# EasyEDA Pro project Geacon3.eprj, board Geacon_1
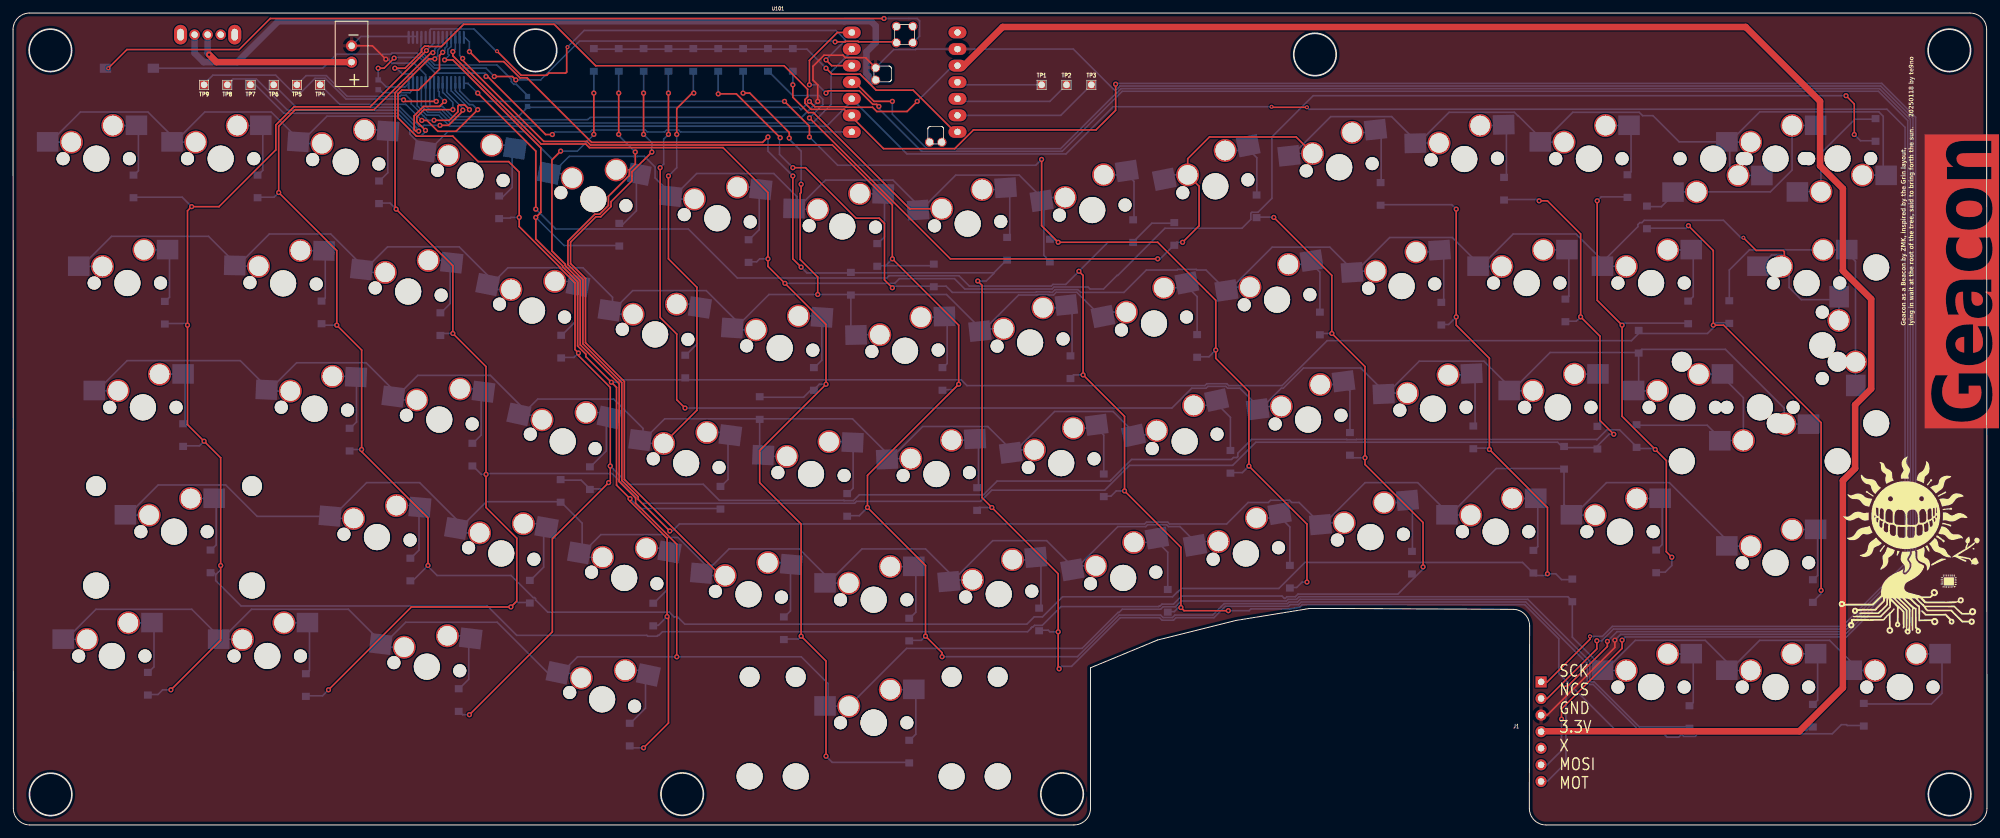
[diagram p1: board, top side]
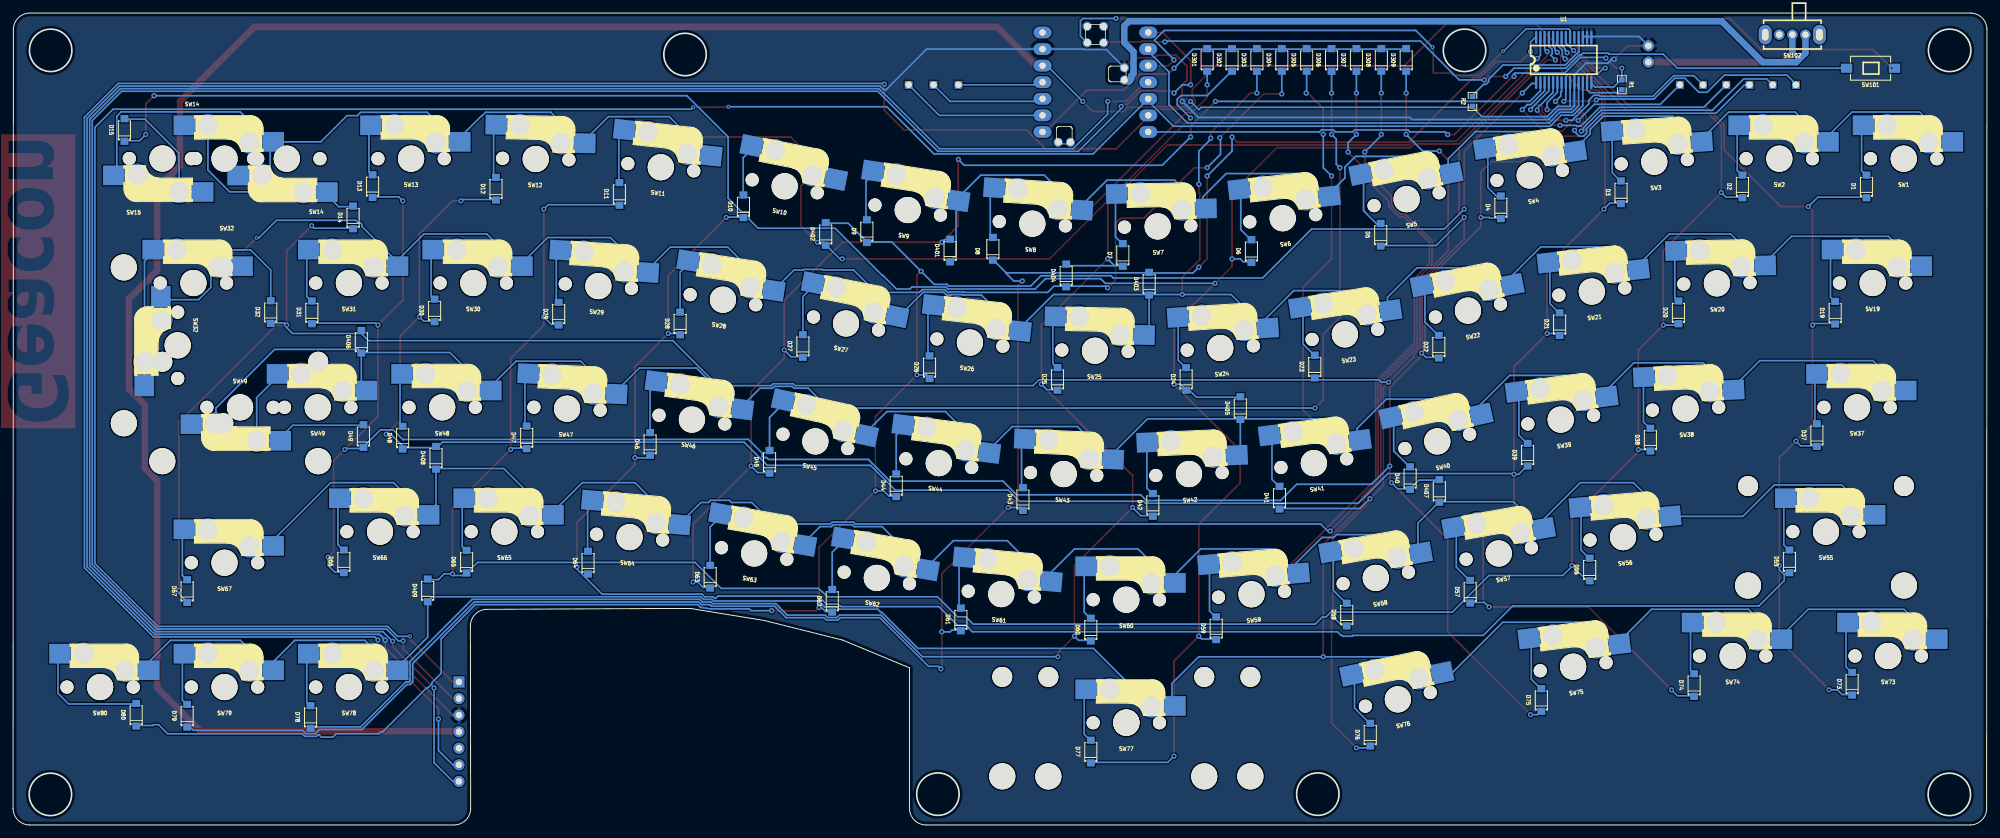
[diagram p2: board, bottom side, seen from below]

Outline 302.31 x 124.41 mm; copper layers: Top Layer, Bottom Layer. Coordinates in mm from the lower left corner of the outline.
Outline path: circle c5.71,118.69 r3.25 ; circle c5.76,4.68 r3.25 ; circle c80.01,118.69 r3.25 ; circle c102.48,4.72 r3.25 ; circle c160.66,4.72 r3.25 ; circle c199.39,118.06 r3.25 ; circle c296.55,118.69 r3.25 ; circle c296.59,4.68 r3.25 ; 0,121.87 arc(0.74,123.66) 2.54,124.41 299.72,124.41 arc(301.52,123.66) 302.26,121.87 302.31,2.54 arc(301.56,0.74) 299.76,0 234.77,0 arc(232.97,0.74) 232.22,2.54 232.27,30.5 arc(231.52,32.29) 229.72,33.04 203.01,33.16 198.51,33.16 187.27,31.33 175.27,28.33 165.02,24.08 165.02,2.54 arc(164.27,0.74) 162.47,0 2.52,0 arc(0.76,0.77) 0.04,2.54 0,121.87
Stack: Top Layer 0.035mm / Dielectric1 1.51mm FR4 er 4.5 / Bottom Layer 0.035mm

## Design rules (mm)
spacing safeClearance (default): track to track 0.152, other pairs 0.152 to 0.3
track width trackWidth (default): min 0.127, default 0.254, max 2.54
differential pair differentialPair (default): width min 0.127, default 0.254, max 2.54; gap min 0.152, default 0.152
via viaSize (default): diameter min 0.5, default 0.61, max 10; hole min 0.3, default 0.305, max 6
net GND uses CopperRegion1

## Placement (name value [footprint] x y rotation side)
BT1  Battery_Cell  [kbd_Parts:Battery_2pin]  51.84 118.14 90 top
D1  D  [SOD-123_L2.7-W1.6-LS3.8-RD]  18.45 97.84 90 bottom
D2  D  [SOD-123_L2.7-W1.6-LS3.8-RD]  37.45 97.84 90 bottom
D3  D  [SOD-123_L2.7-W1.6-LS3.8-RD]  56.04 96.94 90 bottom
D4  D  [SOD-123_L2.7-W1.6-LS3.8-RD]  74.45 94.64 90 bottom
D5  D  [SOD-123_L2.7-W1.6-LS3.8-RD]  92.84 90.44 90 bottom
D6  D  [SOD-123_L2.7-W1.6-LS3.8-RD]  112.65 87.94 90 bottom
D7  D  [SOD-123_L2.7-W1.6-LS3.8-RD]  132.34 87.34 90 bottom
D8  D  [SOD-123_L2.7-W1.6-LS3.8-RD]  152.25 88.29 90 bottom
D9  D  [SOD-123_L2.7-W1.6-LS3.8-RD]  171.55 90.99 90 bottom
D10  D  [SOD-123_L2.7-W1.6-LS3.8-RD]  190.44 94.79 90 bottom
D11  D  [SOD-123_L2.7-W1.6-LS3.8-RD]  209.44 96.69 90 bottom
D12  D  [SOD-123_L2.7-W1.6-LS3.8-RD]  228.34 97.49 90 bottom
D13  D  [SOD-123_L2.7-W1.6-LS3.8-RD]  247.25 97.89 90 bottom
D14  D  [SOD-123_L2.7-W1.6-LS3.8-RD]  250.24 93.09 90 bottom
D15  D  [SOD-123_L2.7-W1.6-LS3.8-RD]  285.25 106.49 90 bottom
D19  D  [SOD-123_L2.7-W1.6-LS3.8-RD]  23.25 78.49 90 bottom
D20  D  [SOD-123_L2.7-W1.6-LS3.8-RD]  47.24 78.54 90 bottom
D21  D  [SOD-123_L2.7-W1.6-LS3.8-RD]  65.45 76.74 90 bottom
D22  D  [SOD-123_L2.7-W1.6-LS3.8-RD]  83.95 73.29 90 bottom
D23  D  [SOD-123_L2.7-W1.6-LS3.8-RD]  102.95 70.24 90 bottom
D24  D  [SOD-123_L2.7-W1.6-LS3.8-RD]  122.65 68.34 90 bottom
D25  D  [SOD-123_L2.7-W1.6-LS3.8-RD]  142.34 68.34 90 bottom
D26  D  [SOD-123_L2.7-W1.6-LS3.8-RD]  161.94 70.14 90 bottom
D27  D  [SOD-123_L2.7-W1.6-LS3.8-RD]  181.34 73.39 90 bottom
D28  D  [SOD-123_L2.7-W1.6-LS3.8-RD]  200.15 76.84 90 bottom
D29  D  [SOD-123_L2.7-W1.6-LS3.8-RD]  218.75 78.34 90 bottom
D30  D  [SOD-123_L2.7-W1.6-LS3.8-RD]  237.75 78.84 90 bottom
D31  D  [SOD-123_L2.7-W1.6-LS3.8-RD]  256.55 78.54 90 bottom
D32  D  [SOD-123_L2.7-W1.6-LS3.8-RD]  262.85 78.59 90 bottom
D37  D  [SOD-123_L2.7-W1.6-LS3.8-RD]  26.05 59.74 90 bottom
D38  D  [SOD-123_L2.7-W1.6-LS3.8-RD]  51.54 59.04 90 bottom
D39  D  [SOD-123_L2.7-W1.6-LS3.8-RD]  70.34 56.74 90 bottom
D40  D  [SOD-123_L2.7-W1.6-LS3.8-RD]  88.34 53.14 90 bottom
D41  D  [SOD-123_L2.7-W1.6-LS3.8-RD]  108.34 50.14 90 bottom
D42  D  [SOD-123_L2.7-W1.6-LS3.8-RD]  127.75 49.04 90 bottom
D43  D  [SOD-123_L2.7-W1.6-LS3.8-RD]  147.65 49.94 90 bottom
D44  D  [SOD-123_L2.7-W1.6-LS3.8-RD]  167.05 52.04 90 bottom
D45  D  [SOD-123_L2.7-W1.6-LS3.8-RD]  186.44 55.64 90 bottom
D46  D  [SOD-123_L2.7-W1.6-LS3.8-RD]  204.75 58.39 90 bottom
D47  D  [SOD-123_L2.7-W1.6-LS3.8-RD]  223.65 59.39 90 bottom
D48  D  [SOD-123_L2.7-W1.6-LS3.8-RD]  242.65 59.34 90 bottom
D49  D  [SOD-123_L2.7-W1.6-LS3.8-RD]  248.65 59.59 90 bottom
D55  D  [SOD-123_L2.7-W1.6-LS3.8-RD]  30.25 40.39 90 bottom
D56  D  [SOD-123_L2.7-W1.6-LS3.8-RD]  60.84 39.14 90 bottom
D57  D  [SOD-123_L2.7-W1.6-LS3.8-RD]  79.15 35.74 90 bottom
D58  D  [SOD-123_L2.7-W1.6-LS3.8-RD]  98.05 32.24 90 bottom
D59  D  [SOD-123_L2.7-W1.6-LS3.8-RD]  118.05 30.14 90 bottom
D60  D  [SOD-123_L2.7-W1.6-LS3.8-RD]  137.25 29.94 90 bottom
D61  D  [SOD-123_L2.7-W1.6-LS3.8-RD]  157.15 31.49 90 bottom
D62  D  [SOD-123_L2.7-W1.6-LS3.8-RD]  176.84 34.34 90 bottom
D63  D  [SOD-123_L2.7-W1.6-LS3.8-RD]  195.55 38.04 90 bottom
D64  D  [SOD-123_L2.7-W1.6-LS3.8-RD]  214.25 40.19 90 bottom
D65  D  [SOD-123_L2.7-W1.6-LS3.8-RD]  232.84 40.34 90 bottom
D66  D  [SOD-123_L2.7-W1.6-LS3.8-RD]  251.65 40.39 90 bottom
D67  D  [SOD-123_L2.7-W1.6-LS3.8-RD]  275.64 35.84 90 bottom
D73  D  [SOD-123_L2.7-W1.6-LS3.8-RD]  20.64 21.64 90 bottom
D74  D  [SOD-123_L2.7-W1.6-LS3.8-RD]  44.84 21.44 90 bottom
D75  D  [SOD-123_L2.7-W1.6-LS3.8-RD]  68.25 19.14 90 bottom
D76  D  [SOD-123_L2.7-W1.6-LS3.8-RD]  94.45 13.84 90 bottom
D77  D  [SOD-123_L2.7-W1.6-LS3.8-RD]  137.25 11.24 90 bottom
D78  D  [SOD-123_L2.7-W1.6-LS3.8-RD]  256.75 16.54 90 bottom
D79  D  [SOD-123_L2.7-W1.6-LS3.8-RD]  275.64 16.74 90 bottom
D80  D  [SOD-123_L2.7-W1.6-LS3.8-RD]  283.44 16.89 90 bottom
D301  D  [SOD-123_L2.7-W1.6-LS3.8-RD]  119.43 117.22 90 bottom
D302  D  [SOD-123_L2.7-W1.6-LS3.8-RD]  115.62 117.22 90 bottom
D303  D  [SOD-123_L2.7-W1.6-LS3.8-RD]  111.81 117.22 90 bottom
D304  D  [SOD-123_L2.7-W1.6-LS3.8-RD]  108 117.22 90 bottom
D305  D  [SOD-123_L2.7-W1.6-LS3.8-RD]  104.19 117.22 90 bottom
D306  D  [SOD-123_L2.7-W1.6-LS3.8-RD]  100.38 117.22 90 bottom
D307  D  [SOD-123_L2.7-W1.6-LS3.8-RD]  96.56 117.22 90 bottom
D308  D  [SOD-123_L2.7-W1.6-LS3.8-RD]  92.76 117.22 90 bottom
D309  D  [SOD-123_L2.7-W1.6-LS3.8-RD]  88.95 117.22 90 bottom
D401  D  [SOD-123_L2.7-W1.6-LS3.8-RD]  158.8 88.01 90 bottom
D402  D  [SOD-123_L2.7-W1.6-LS3.8-RD]  177.84 90.55 90 bottom
D403  D  [SOD-123_L2.7-W1.6-LS3.8-RD]  128.31 82.93 90 bottom
D404  D  [SOD-123_L2.7-W1.6-LS3.8-RD]  141.02 84.2 90 bottom
D405  D  [SOD-123_L2.7-W1.6-LS3.8-RD]  114.34 63.88 90 bottom
D406  D  [SOD-123_L2.7-W1.6-LS3.8-RD]  248.97 74.04 90 bottom
D407  D  [SOD-123_L2.7-W1.6-LS3.8-RD]  83.87 51.18 90 bottom
D408  D  [SOD-123_L2.7-W1.6-LS3.8-RD]  237.53 56.26 90 bottom
D409  D  [SOD-123_L2.7-W1.6-LS3.8-RD]  238.81 35.94 90 bottom
J1  ~  [roBa:pmw3610_connector]  234.02 14.29 0 top
NOREF  -  [clipboard:2295cc0d-1d4d-4a4b-a6d2-58b9edf6c2ed]  131.81 15.69 0 top
R1  10K  [R0603]  55.92 113.41 270 bottom
R2  10K  [R0603]  78.79 110.87 90 bottom
SW1  SW_PUSH  [kbd_SW:CherryMX_Hotswap_1u]  12.74 102.09 180 bottom
SW2  SW_PUSH  [kbd_SW:CherryMX_Hotswap_1u]  31.8 102.09 180 bottom
SW3  SW_PUSH  [kbd_SW:CherryMX_Hotswap_1u]  50.95 101.62 176.2 bottom
SW4  SW_PUSH  [kbd_SW:CherryMX_Hotswap_1u]  70.03 99.53 171.2 bottom
SW5  SW_PUSH  [kbd_SW:CherryMX_Hotswap_1u]  88.88 95.89 168.8 bottom
SW6  SW_PUSH  [kbd_SW:CherryMX_Hotswap_1u]  107.85 92.97 173.8 bottom
SW7  SW_PUSH  [kbd_SW:CherryMX_Hotswap_1u]  127.01 91.71 178.8 bottom
SW8  SW_PUSH  [kbd_SW:CherryMX_Hotswap_1u]  146.2 92.13 183.8 bottom
SW9  SW_PUSH  [kbd_SW:CherryMX_Hotswap_1u]  165.28 94.22 188.8 bottom
SW10  SW_PUSH  [kbd_SW:CherryMX_Hotswap_1u]  184.13 97.86 191.2 bottom
SW11  SW_PUSH  [kbd_SW:CherryMX_Hotswap_1u]  203.1 100.78 186.2 bottom
SW12  SW_PUSH  [kbd_SW:CherryMX_Hotswap_1u]  222.26 102.04 181.2 bottom
SW13  SW_PUSH  [kbd_SW:CherryMX_Hotswap_1u]  241.34 102.09 180 bottom
SW14  SW_PUSH  [kbd_SW:CherryMX_Hotswap_1u]  269.92 102.09 180 bottom
SW14#2  -  [kbd_SW:CherryMX_Hotswap_1u]  260.38 102.09 0 bottom
SW15  SW_PUSH  [kbd_SW:CherryMX_Hotswap_1u]  279.42 102.12 0 bottom
SW19  SW_PUSH  [kbd_SW:CherryMX_Hotswap_1u]  17.51 83.04 180 bottom
SW20  SW_PUSH  [kbd_SW:CherryMX_Hotswap_1u]  41.36 82.99 178.8 bottom
SW21  SW_PUSH  [kbd_SW:CherryMX_Hotswap_1u]  60.51 81.73 173.8 bottom
SW22  SW_PUSH  [kbd_SW:CherryMX_Hotswap_1u]  79.48 78.81 168.8 bottom
SW23  SW_PUSH  [kbd_SW:CherryMX_Hotswap_1u]  98.33 75.17 171.2 bottom
SW24  SW_PUSH  [kbd_SW:CherryMX_Hotswap_1u]  117.42 73.08 176.2 bottom
SW25  SW_PUSH  [kbd_SW:CherryMX_Hotswap_1u]  136.61 72.66 181.2 bottom
SW26  SW_PUSH  [kbd_SW:CherryMX_Hotswap_1u]  155.76 73.92 186.2 bottom
SW27  SW_PUSH  [kbd_SW:CherryMX_Hotswap_1u]  174.74 76.84 191.2 bottom
SW28  SW_PUSH  [kbd_SW:CherryMX_Hotswap_1u]  193.58 80.48 188.8 bottom
SW29  SW_PUSH  [kbd_SW:CherryMX_Hotswap_1u]  212.66 82.57 183.8 bottom
SW30  SW_PUSH  [kbd_SW:CherryMX_Hotswap_1u]  231.82 83.04 180 bottom
SW31  SW_PUSH  [kbd_SW:CherryMX_Hotswap_1u]  250.87 83.04 180 bottom
SW32  SW_PUSH  [kbd_SW:CherryMX_Hotswap_1u]  274.68 83.04 180 bottom
SW32#2  -  [kbd_SW:CherryMX_Hotswap_1u]  277.09 73.49 90 bottom
SW37  SW_PUSH  [kbd_SW:CherryMX_Hotswap_1u]  19.89 63.99 180 bottom
SW38  SW_PUSH  [kbd_SW:CherryMX_Hotswap_1u]  46.15 63.78 177.5 bottom
SW39  SW_PUSH  [kbd_SW:CherryMX_Hotswap_1u]  65.28 62.11 172.5 bottom
SW40  SW_PUSH  [kbd_SW:CherryMX_Hotswap_1u]  84.18 58.77 167.5 bottom
SW41  SW_PUSH  [kbd_SW:CherryMX_Hotswap_1u]  103.09 55.44 172.5 bottom
SW42  SW_PUSH  [kbd_SW:CherryMX_Hotswap_1u]  122.21 53.77 177.5 bottom
SW43  SW_PUSH  [kbd_SW:CherryMX_Hotswap_1u]  141.41 53.77 182.5 bottom
SW44  SW_PUSH  [kbd_SW:CherryMX_Hotswap_1u]  160.53 55.44 187.5 bottom
SW45  SW_PUSH  [kbd_SW:CherryMX_Hotswap_1u#2]  179.43 58.77 192.5 bottom
SW46  SW_PUSH  [kbd_SW:CherryMX_Hotswap_1u]  198.34 62.11 187.5 bottom
SW47  SW_PUSH  [kbd_SW:CherryMX_Hotswap_1u]  217.46 63.78 182.5 bottom
SW48  SW_PUSH  [kbd_SW:CherryMX_Hotswap_1u]  236.58 63.99 180 bottom
SW49  SW_PUSH  [kbd_SW:CherryMX_Hotswap_1u]  255.65 63.99 180 bottom
SW49#2  -  [kbd_SW:CherryMX_Hotswap_1u]  267.54 63.99 0 bottom
SW55  SW_PUSH  [kbd_SW:CherryMX_Hotswap_1u]  24.65 44.94 180 bottom
SW56  SW_PUSH  [kbd_SW:CherryMX_Hotswap_1u]  55.73 44.1 175 bottom
SW57  SW_PUSH  [kbd_SW:CherryMX_Hotswap_1u]  74.77 41.6 170 bottom
SW58  SW_PUSH  [kbd_SW:CherryMX_Hotswap_1u]  93.6 37.85 170 bottom
SW59  SW_PUSH  [kbd_SW:CherryMX_Hotswap_1u]  112.63 35.35 175 bottom
SW60  SW_PUSH  [kbd_SW:CherryMX_Hotswap_1u]  131.81 34.51 180 bottom
SW61  SW_PUSH  [kbd_SW:CherryMX_Hotswap_1u]  150.96 35.37 185 bottom
SW62  SW_PUSH  [kbd_SW:CherryMX_Hotswap_1u]  170.02 37.85 190 bottom
SW63  SW_PUSH  [kbd_SW:CherryMX_Hotswap_1u]  188.8 41.6 190 bottom
SW64  SW_PUSH  [kbd_SW:CherryMX_Hotswap_1u]  207.88 44.1 185 bottom
SW65  SW_PUSH  [kbd_SW:CherryMX_Hotswap_1u]  227.06 44.94 180 bottom
SW66  SW_PUSH  [kbd_SW:CherryMX_Hotswap_1u]  246.11 44.94 180 bottom
SW67  SW_PUSH  [kbd_SW:CherryMX_Hotswap_1u]  269.92 40.18 180 bottom
SW73  SW_PUSH  [kbd_SW:CherryMX_Hotswap_1u]  15.13 25.89 180 bottom
SW74  SW_PUSH  [kbd_SW:CherryMX_Hotswap_1u]  38.94 25.89 180 bottom
SW75  SW_PUSH  [kbd_SW:CherryMX_Hotswap_1u]  63.37 24.25 173 bottom
SW76  SW_PUSH  [kbd_SW:CherryMX_Hotswap_1u]  90.22 19.25 168.1 bottom
SW77  SW_PUSH  [kbd_SW:CherryMX_Hotswap_1u]  131.81 15.66 180 bottom
SW78  SW_PUSH  [kbd_SW:CherryMX_Hotswap_1u]  250.87 21.13 180 bottom
SW79  SW_PUSH  [kbd_SW:CherryMX_Hotswap_1u]  269.92 21.13 180 bottom
SW80  SW_PUSH  [kbd_SW:CherryMX_Hotswap_1u]  288.97 21.13 180 bottom
SW101  SW_DIP_x01  [SW-SMD_L6.0-W3.5-LS8.0]  17.82 115.95 180 bottom
SW102  SW_SPDT  [SW-TH_SK12D07VG5]  29.8 121.1 0 bottom
SWH1  -  [kbd_SW:CherryMX_stab_2u]  277.09 73.49 90 top
SWH2  -  [kbd_SW:CherryMX_stab_2u]  267.51 63.99 0 top
SWH2#2  -  [kbd_SW:CherryMX_stab_2u]  131.81 15.69 0 top
SWH3  -  [kbd_SW:CherryMX_stab_2u]  24.65 44.94 0 top
TP1  TestPoint  [TestPoint:TestPoint_THTPad_1.0x1.0mm_Drill0.5mm]  157.53 113.41 0 top
TP2  TestPoint  [TestPoint:TestPoint_THTPad_1.0x1.0mm_Drill0.5mm]  161.34 113.41 0 top
TP3  TestPoint  [TestPoint:TestPoint_THTPad_1.0x1.0mm_Drill0.5mm]  165.15 113.41 0 top
TP4  TestPoint  [TestPoint:TestPoint_THTPad_1.0x1.0mm_Drill0.5mm]  47.03 113.41 180 top
TP5  TestPoint  [TestPoint:TestPoint_THTPad_1.0x1.0mm_Drill0.5mm]  43.48 113.41 180 top
TP6  TestPoint  [TestPoint:TestPoint_THTPad_1.0x1.0mm_Drill0.5mm]  39.92 113.41 180 top
TP7  TestPoint  [TestPoint:TestPoint_THTPad_1.0x1.0mm_Drill0.5mm]  36.37 113.41 180 top
TP8  TestPoint  [TestPoint:TestPoint_THTPad_1.0x1.0mm_Drill0.5mm]  32.81 113.41 180 top
TP9  TestPoint  [TestPoint:TestPoint_THTPad_1.0x1.0mm_Drill0.5mm]  29.26 113.41 180 top
U1  xiao-ble  [SSOP-28_L10.2-W5.3-P0.65-LS7.8-BL]  64.81 117.22 180 bottom
U101  xiao-ble  [mcu:xiao-ble-tht]  136.55 113.81 0 top

## Footprints (pads in the part's own frame, mm; a bottom-side part is the same pattern mirrored in y, then rotated)
clipboard:2295cc0d-1d4d-4a4b-a6d2-58b9edf6c2ed
  round 3.05 hole 3.05: (-19,7) (19,7)
  round 4 hole 4: (-19,-8.24) (0,0) (19,-8.24)
kbd_Parts:Battery_2pin
  round 1.7 hole 1: 1(-1.25,0) 2(1.25,0)
kbd_SW:CherryMX_Hotswap_1u
  round 2 hole 2: (-5.08,0) (5.08,0)
  round 4 hole 4: (0,0)
  round 3.5 hole 3: 1(3.81,2.54) 2(-2.54,5.08)
  rect 3.3x3 smd: 1(7.45,2.58) 2(-6.15,5.12)
kbd_SW:CherryMX_Hotswap_1u#2
  round 2 hole 2: (-5.08,0) (5.08,0)
  round 4 hole 4: (0,0)
  round 3.5 hole 3: 1(3.81,2.54) 2(-2.54,5.08)
  rect 3.3x3 smd: 1(7.45,2.58) 2(-6.15,5.12)
kbd_SW:CherryMX_stab_2u
  round 3.048 hole 3.048: (-11.938,6.985) (11.938,6.985)
  round 3.988 hole 3.988: (-11.938,-8.255) (11.938,-8.255)
mcu:xiao-ble-tht
  oval 2.75x1.8 hole 1: 1(-8.095,7.62) 2(-8.095,5.08) 3(-8.095,2.54) 4(-8.095,0) 5(-8.095,-2.54) 6(-8.095,-5.08) 7(-8.095,-7.62) 8(8.095,-7.62) 9(8.095,-5.08) 10(8.095,-2.54) 11(8.095,0) 12(8.095,2.54) 13(8.095,5.08) 14(8.095,7.62)
  round 1.397 hole 1.016: 15(-1.271,8.571) 16(1.27,8.572) 17(-1.271,6.031) 18(1.269,6.031) 19(-4.446,0.316) 20(-4.446,2.221) 21(3.809,-9.209) 22(5.714,-9.209)
R0603
  rect 0.806x0.864 smd: 1(-0.753,0) 2(0.753,0)
roBa:pmw3610_connector
  rect 1.7x1.7 hole 1: 1(0,7.62)
  round 1.7 hole 1: 2(0,5.08) 3(0,2.54) 4(0,0) 5(0,-2.54) 6(0,-5.08) 7(0,-7.62)
SOD-123_L2.7-W1.6-LS3.8-RD
  rect 1.1x1.2 smd: 1(-1.735,0) 2(1.735,0)
SSOP-28_L10.2-W5.3-P0.65-LS7.8-BL
  oval 0.364x2.015 smd: 1(-4.225,-3.455) 2(-3.575,-3.455) 3(-2.925,-3.455) 4(-2.275,-3.455) 5(-1.625,-3.455) 6(-0.975,-3.455) 7(-0.325,-3.455) 8(0.325,-3.455) 9(0.975,-3.455) 10(1.625,-3.455) 11(2.275,-3.455) 12(2.925,-3.455) 13(3.575,-3.455) 14(4.225,-3.455) 15(4.225,3.455) 16(3.575,3.455) 17(2.925,3.455) 18(2.275,3.455) 19(1.625,3.455) 20(0.975,3.455) 21(0.325,3.455) 22(-0.325,3.455) 23(-0.975,3.455) 24(-1.625,3.455) 25(-2.275,3.455) 26(-2.925,3.455) 27(-3.575,3.455) 28(-4.225,3.455)
SW-SMD_L6.0-W3.5-LS8.0
  rect 1.74x1.4 smd: 1(-3.67,0) 2(3.67,0)
SW-TH_SK12D07VG5
  oval 1.6x1.6 hole 1: 1(-2,0) 2(0,0) 3(2,0)
  oval 2x3 hole 1x1.8: 4(4.15,0) 5(-4.15,0)
TestPoint:TestPoint_THTPad_1.0x1.0mm_Drill0.5mm
  rect 1.194x1.194 hole 1.001: 1(0,0)

## Nets
3.3V: J1.4 R2.1 U1.9 U101.12
GND: BT1.2 J1.3 U1.10 U1.15 U1.16 U1.17 U101.13 U101.20
BAT+: SW102.1 U101.19
CS1: U1.11 U101.2
CS2: J1.2 U101.1
INT: D301.2 D302.2 D303.2 D304.2 D305.2 D306.2 D307.2 D308.2 D309.2 U101.8
INTA: U1.20 U101.3
MISO: R1.1 U1.14 U101.7
MOSI: J1.6 R1.2 U1.13 U101.6
MOT: J1.7 U101.4
NET-(BT1-+): BT1.1 SW102.2
NET-(D1-A): D1.2 SW1.2
NET-(D2-A): D2.2 SW2.2
NET-(D3-A): D3.2 SW3.2
NET-(D4-A): D4.2 SW4.2
NET-(D5-A): D5.2 SW5.2
NET-(D6-A): D6.2 SW6.2
NET-(D7-A): D7.2 SW7.2
NET-(D8-A): D8.2 SW8.2
NET-(D9-A): D9.2 SW9.2
NET-(D10-A): D10.2 SW10.2
NET-(D11-A): D11.2 SW11.2
NET-(D12-A): D12.2 SW12.2
NET-(D13-A): D13.2 SW13.2
NET-(D14-A): D14.2 SW14.2 SW14#2.2
NET-(D15-A): D15.2 SW15.2
NET-(D19-A): D19.2 SW19.2
NET-(D20-A): D20.2 SW20.2
NET-(D21-A): D21.2 SW21.2
NET-(D22-A): D22.2 SW22.2
NET-(D23-A): D23.2 SW23.2
NET-(D24-A): D24.2 SW24.2
NET-(D25-A): D25.2 SW25.2
NET-(D26-A): D26.2 SW26.2
NET-(D27-A): D27.2 SW27.2
NET-(D28-A): D28.2 SW28.2
NET-(D29-A): D29.2 SW29.2
NET-(D30-A): D30.2 SW30.2
NET-(D31-A): D31.2 SW31.2
NET-(D32-A): D32.2 SW32.2 SW32#2.2
NET-(D37-A): D37.2 SW37.2
NET-(D38-A): D38.2 SW38.2
NET-(D39-A): D39.2 SW39.2
NET-(D40-A): D40.2 SW40.2
NET-(D41-A): D41.2 SW41.2
NET-(D42-A): D42.2 SW42.2
NET-(D43-A): D43.2 SW43.2
NET-(D44-A): D44.2 SW44.2
NET-(D45-A): D45.2 SW45.2
NET-(D46-A): D46.2 SW46.2
NET-(D47-A): D47.2 SW47.2
NET-(D48-A): D48.2 SW48.2
NET-(D49-A): D49.2 SW49.2 SW49#2.2
NET-(D55-A): D55.2 SW55.2
NET-(D56-A): D56.2 SW56.2
NET-(D57-A): D57.2 SW57.2
NET-(D58-A): D58.2 SW58.2
NET-(D59-A): D59.2 SW59.2
NET-(D60-A): D60.2 SW60.2
NET-(D61-A): D61.2 SW61.2
NET-(D62-A): D62.2 SW62.2
NET-(D63-A): D63.2 SW63.2
NET-(D64-A): D64.2 SW64.2
NET-(D65-A): D65.2 SW65.2
NET-(D66-A): D66.2 SW66.2
NET-(D67-A): D67.2 SW67.2
NET-(D73-A): D73.2 SW73.2
NET-(D74-A): D74.2 SW74.2
NET-(D75-A): D75.2 SW75.2
NET-(D76-A): D76.2 SW76.2
NET-(D77-A): D77.2 SW77.2
NET-(D78-A): D78.2 SW78.2
NET-(D79-A): D79.2 SW79.2
NET-(D80-A): D80.2 SW80.2
NET-(D301-K): D301.1 D401.1 SW1.1 SW2.1 SW3.1 SW4.1 SW5.1 SW6.1 SW7.1 SW8.1 SW9.1
NET-(D302-K): D302.1 D402.1 SW10.1 SW11.1 SW12.1 SW13.1 SW14.1 SW14#2.1 SW15.1
NET-(D303-K): D303.1 D403.1 SW19.1 SW20.1 SW21.1 SW22.1 SW23.1 SW24.1 SW25.1 SW26.1 SW27.1
NET-(D304-K): D304.1 D404.1 SW28.1 SW29.1 SW30.1 SW31.1 SW32.1 SW32#2.1
NET-(D305-K): D305.1 D405.1 SW37.1 SW38.1 SW39.1 SW40.1 SW41.1 SW42.1 SW43.1 SW44.1 SW45.1
NET-(D306-K): D306.1 D406.1 SW46.1 SW47.1 SW48.1 SW49.1 SW49#2.1
NET-(D307-K): D307.1 D407.1 SW55.1 SW56.1 SW57.1 SW58.1 SW59.1 SW60.1 SW61.1 SW62.1 SW63.1
NET-(D308-K): D308.1 D408.1 SW64.1 SW65.1 SW66.1 SW67.1
NET-(D309-K): D309.1 D409.1 SW73.1 SW74.1 SW75.1 SW76.1 SW77.1 SW78.1 SW79.1 SW80.1
NET-(SW101-PAD2): SW101.2 U101.18
NET-(U1-GPB2): TP4.1 U1.3
NET-(U1-GPB3): TP5.1 U1.4
NET-(U1-GPB4): TP6.1 U1.5
NET-(U1-GPB5): TP7.1 U1.6
NET-(U1-GPB6): TP8.1 U1.7
NET-(U1-GPB7): TP9.1 U1.8
NET-(U1-~{RESET}): R2.2 U1.18
NET-(U101-A5_MISO{SLASH}1.14): TP2.1 U101.10
NET-(U101-A6_MOSI{SLASH}1.15): TP1.1 U101.11
NET-(U101-A7_SCK{SLASH}1.13): TP3.1 U101.9
NET-(U101-RESET): SW101.1 U101.17
S0: D1.1 D10.1 D19.1 D28.1 D37.1 D46.1 D55.1 D64.1 D73.1 U1.21
S1: D2.1 D11.1 D20.1 D29.1 D38.1 D47.1 D56.1 D65.1 D409.2 U1.22
S2: D3.1 D12.1 D21.1 D30.1 D39.1 D48.1 D57.1 D74.1 D408.2 U1.23
S3: D4.1 D13.1 D22.1 D31.1 D40.1 D49.1 D66.1 D75.1 D407.2 U1.24
S4: D5.1 D14.1 D23.1 D32.1 D41.1 D58.1 D67.1 D76.1 D406.2 U1.25
S5: D6.1 D15.1 D24.1 D59.1 D77.1 D405.2 U1.26
S6: D7.1 D25.1 D42.1 D60.1 D78.1 D404.2 U1.27
S7: D8.1 D43.1 D61.1 D79.1 D403.2 U1.28
S8: D9.1 D26.1 D44.1 D62.1 D80.1 D402.2 U1.1
S9: D27.1 D45.1 D63.1 D401.2 U1.2
SCK: J1.1 U1.12 U101.5
UNCONNECTED-(J1-NC-PAD5): J1.5
UNCONNECTED-(SW102-C-PAD3): SW102.3
UNCONNECTED-(U1-INTB-PAD19): U1.19
UNCONNECTED-(U101-5V-PAD14): U101.14
UNCONNECTED-(U101-A30_SWCLK-PAD16): U101.16
UNCONNECTED-(U101-A31_SWDIO-PAD15): U101.15
UNCONNECTED-(U101-NFC1{SLASH}0.09_H-PAD21): U101.21
UNCONNECTED-(U101-NFC2{SLASH}0.10_H-PAD22): U101.22

Pads without a net: SW102 4 5

## Via types
v1: diameter 0.8, hole 0.4, Top Layer to Bottom Layer, 152 vias
v2: diameter 0.61, hole 0.305, Top Layer to Bottom Layer, 7 vias

## Routing (per net, layer and track width the routed paths; a pad name or vN(x,y) marks a point on that pad's centre or on a via; arc(x,y) is an arc through that point)
3.3V: length 373
  Top Layer w0.25: v1(138.47,110.87) 136.93,109.32 132.28,109.32 131.63,109.97 127.54,109.97 127.46,110.05 122.79,110.05 v1(121.97,110.87)
  Top Layer w1: 144.16,116.35 144.2,116.32 145.61,116.32 151.56,122.27 265.36,122.27 276.74,110.88 276.74,101.01 280.24,97.51 280.24,84.93 284.57,80.6 284.57,66.83 282.11,64.37 282.11,54.63 280.24,52.76 280.24,21.02 273.57,14.35 234.08,14.35 J1.4
  Bottom Layer w0.25: v1(138.47,110.87) 143.95,116.35 144.16,116.35 ; 63.84,113.62 63.84,110.17 63.91,110.1 65.76,110.1 67.33,108.53 77.36,108.53 78.79,109.96 120.34,109.96 120.7,109.6 v1(121.97,110.87)
GND: length 408.2
  Top Layer w0.25: v1(123.23,110.87) 123.23,113.41 122.51,114.14 122.51,116.25 124.2,117.95 127.09,117.95 127.47,117.57 130.56,117.57 U101.20 ; J1.3 234.96,16.83 245.31,27.19 v1(245.31,28.31) ; v1(57.09,117.32) 55.03,119.39 BT1.2
  Bottom Layer w0.25: v1(245.31,28.31) 246.22,29.21 280.62,29.21 290.98,39.57 290.98,108.27 286.02,113.22 169.54,113.22 168.95,112.64 168.63,112.64 162.38,118.89 138.31,118.89 138.24,118.82 134.89,118.82 U101.20 ; v1(123.23,110.87) 120.78,108.41 88.39,108.41 88.06,108.08 67.14,108.08 65.58,109.65 63.73,109.65 63.19,110.18 U1.10 63.19,114.94 61.4,116.73 58.04,116.73 57.59,117.18 57.59,117.28 57.55,117.32 v1(57.09,117.32) ; 61.89,120.82 53.28,120.82 BT1.2
BAT+: length 120.1
  Bottom Layer w1: SW102.1 27.8,118.27 29.19,116.88 34.35,116.88 40.61,123.15 127.31,123.15 127.31,123.16 131.4,123.16 132.12,122.43 132.12,119.89 130.7,118.46 130.7,115.12 131.05,114.78 131.05,114.56 arc(131.15,114.16) 131.44,113.86
CS1: length 78.5
  Bottom Layer w0.25: 62.54,113.62 62.54,110.2 63.54,109.2 65.39,109.2 67.03,107.56 122.46,107.56 125.28,110.38 125.28,115.39 128.78,118.89 128.93,118.89
CS2: length 324.5
  Top Layer w0.25: 128.93,121.43 126.24,121.43 121.97,117.15 v1(121.97,113.41) ; v1(124.51,112.14) 124.86,112.49 129.6,112.49 131.68,110.42 132.27,110.42 v1(132.6,110.1) ; J1.2 234.96,19.37 242.56,26.98 v1(242.56,28.22)
  Bottom Layer w0.25: v1(121.97,113.41) 123.23,113.41 v1(124.51,112.14) ; v1(132.6,110.1) 132.6,109.76 139.14,103.22 160.67,103.22 169.87,112.42 285.69,112.42 290.17,107.94 290.17,39.91 280.28,30.02 245.1,30.02 243.31,28.22 v1(242.56,28.22)
INT: length 60.5
  Top Layer w0.25: 144.16,106.19 144.16,106.28 137.85,112.59 132.19,112.59 129.74,115.03 125.42,115.03 v1(124.51,115.95)
  Bottom Layer w0.25: v1(124.51,115.95) 121.59,118.87 88.95,118.87
INTA: length 82.3
  Top Layer w0.249: v2(84.92,119.19) 84.79,119.07 84.79,115.38 84.62,115.21 82.08,115.21 81.74,114.88 77.81,114.88 v2(74.12,118.56)
  Top Layer w0.25: 128.93,116.35 125.38,116.35 v1(124.51,117.22)
  Bottom Layer w0.249: 63.84,120.82 63.84,120.95 63.86,120.97 63.86,121.81 64.02,121.97 70.58,121.97 74,118.56 v2(74.12,118.56)
  Bottom Layer w0.25: v1(124.51,117.22) 124.64,117.36 124.64,117.41 127.49,120.25 126,121.74 87.47,121.74 v2(84.92,119.19)
MISO: length 86.5
  Top Layer w0.25: v1(58.36,117.5) 56.81,115.95 v1(55.92,115.95) ; v1(82.59,105.79) 81.57,105.79 72.68,114.68 v1(72.44,114.68)